# EAGLE schematic Resistor_Resistor (EAGLE 8.3.0), part 1 of 43 (continued)
## Parts (continued)
R323  10K  RESISTOR_0201  [0201]
R324  10K  RESISTOR_0201  [0201]
R325  10K  RESISTOR_0201  [0201]
R326  10K  RESISTOR_0201  [0201]
R327  10K  RESISTOR_0201  [0201]
R328  10K  RESISTOR_0201  [0201]
R329  10K  RESISTOR_0201  [0201]
R330  10K  RESISTOR_0201  [0201]
R331  10K  RESISTOR_0201  [0201]
R332  10K  RESISTOR_0201  [0201]
R333  10K  RESISTOR_0201  [0201]
R334  10K  RESISTOR_0201  [0201]
R335  10K  RESISTOR_0201  [0201]
R336  10K  RESISTOR_0201  [0201]
R337  10K  RESISTOR_0201  [0201]
R338  10K  RESISTOR_0201  [0201]
R339  10K  RESISTOR_0201  [0201]
R340  10K  RESISTOR_0201  [0201]
R341  10K  RESISTOR_0201  [0201]
R342  10K  RESISTOR_0201  [0201]
R343  10K  RESISTOR_0201  [0201]
R344  10K  RESISTOR_0201  [0201]
R345  10K  RESISTOR_0201  [0201]
R346  10K  RESISTOR_0201  [0201]
R347  10K  RESISTOR_0201  [0201]
R348  10K  RESISTOR_0201  [0201]
R349  10K  RESISTOR_0201  [0201]
R350  10K  RESISTOR_0201  [0201]
R351  10K  RESISTOR_0201  [0201]
R352  10K  RESISTOR_0201  [0201]
R353  10K  RESISTOR_0201  [0201]
R354  10K  RESISTOR_0201  [0201]
R355  10K  RESISTOR_0201  [0201]
R356  10K  RESISTOR_0201  [0201]
R357  10K  RESISTOR_0201  [0201]
R358  10K  RESISTOR_0201  [0201]
R359  10K  RESISTOR_0201  [0201]
R360  10K  RESISTOR_0201  [0201]
R361  10K  RESISTOR_0201  [0201]
R362  10K  RESISTOR_0201  [0201]
R363  10K  RESISTOR_0201  [0201]
R364  10K  RESISTOR_0201  [0201]
R365  10K  RESISTOR_0201  [0201]
R366  10K  RESISTOR_0201  [0201]
R367  10K  RESISTOR_0201  [0201]
R368  10K  RESISTOR_0201  [0201]
R369  10K  RESISTOR_0201  [0201]
R370  10K  RESISTOR_0201  [0201]
R371  10K  RESISTOR_0201  [0201]
R372  10K  RESISTOR_0201  [0201]
R373  10K  RESISTOR_0201  [0201]
R374  10K  RESISTOR_0201  [0201]
R375  10K  RESISTOR_0201  [0201]
R376  10K  RESISTOR_0201  [0201]
R377  10K  RESISTOR_0201  [0201]
R378  10K  RESISTOR_0201  [0201]
R379  10K  RESISTOR_0201  [0201]
R380  10K  RESISTOR_0201  [0201]
R381  10K  RESISTOR_0201  [0201]
R382  10K  RESISTOR_0201  [0201]
R383  10K  RESISTOR_0201  [0201]
R384  10K  RESISTOR_0201  [0201]
R385  10K  RESISTOR_0201  [0201]
R386  10K  RESISTOR_0201  [0201]
R387  10K  RESISTOR_0201  [0201]
R388  10K  RESISTOR_0201  [0201]
R389  10K  RESISTOR_0201  [0201]
R390  10K  RESISTOR_0201  [0201]
R391  10K  RESISTOR_0201  [0201]
R392  10K  RESISTOR_0201  [0201]
R393  10K  RESISTOR_0201  [0201]
R394  10K  RESISTOR_0201  [0201]
R395  10K  RESISTOR_0201  [0201]
R396  10K  RESISTOR_0201  [0201]
R397  10K  RESISTOR_0201  [0201]
R398  10K  RESISTOR_0201  [0201]
R399  10K  RESISTOR_0201  [0201]
R400  10K  RESISTOR_0201  [0201]
R401  10K  RESISTOR_0201  [0201]
R402  10K  RESISTOR_0201  [0201]
R403  10K  RESISTOR_0201  [0201]
R404  10K  RESISTOR_0201  [0201]
R405  10K  RESISTOR_0201  [0201]
R406  10K  RESISTOR_0201  [0201]
R407  10K  RESISTOR_0201  [0201]
R408  10K  RESISTOR_0201  [0201]
R409  10K  RESISTOR_0201  [0201]
R410  10K  RESISTOR_0201  [0201]
R411  10K  RESISTOR_0201  [0201]
R412  10K  RESISTOR_0201  [0201]
R413  10K  RESISTOR_0201  [0201]
R414  10K  RESISTOR_0201  [0201]
R415  10K  RESISTOR_0201  [0201]
R416  10K  RESISTOR_0201  [0201]
R417  10K  RESISTOR_0201  [0201]
R418  10K  RESISTOR_0201  [0201]
R419  10K  RESISTOR_0201  [0201]
R420  10K  RESISTOR_0201  [0201]
R421  10K  RESISTOR_0201  [0201]
R422  10K  RESISTOR_0201  [0201]
R423  10K  RESISTOR_0201  [0201]
R424  10K  RESISTOR_0201  [0201]
R425  10K  RESISTOR_0201  [0201]
R426  10K  RESISTOR_0201  [0201]
R427  10K  RESISTOR_0201  [0201]
R428  10K  RESISTOR_0201  [0201]
R429  10K  RESISTOR_0201  [0201]
R430  10K  RESISTOR_0201  [0201]
R431  10K  RESISTOR_0201  [0201]
R432  10K  RESISTOR_0201  [0201]
R433  10K  RESISTOR_0201  [0201]
R434  10K  RESISTOR_0201  [0201]
R435  10K  RESISTOR_0201  [0201]
R436  10K  RESISTOR_0201  [0201]
R437  10K  RESISTOR_0201  [0201]
R438  10K  RESISTOR_0201  [0201]
R439  10K  RESISTOR_0201  [0201]
R440  10K  RESISTOR_0201  [0201]
R441  10K  RESISTOR_0201  [0201]
R442  10K  RESISTOR_0201  [0201]
R443  10K  RESISTOR_0201  [0201]
R444  10K  RESISTOR_0201  [0201]
R445  10K  RESISTOR_0201  [0201]
R446  10K  RESISTOR_0201  [0201]
R447  10K  RESISTOR_0201  [0201]
R448  10K  RESISTOR_0201  [0201]
R449  10K  RESISTOR_0201  [0201]
R450  10K  RESISTOR_0201  [0201]
R451  10K  RESISTOR_0201  [0201]
R452  10K  RESISTOR_0201  [0201]
R453  10K  RESISTOR_0201  [0201]
R454  10K  RESISTOR_0201  [0201]
R455  10K  RESISTOR_0201  [0201]
R456  10K  RESISTOR_0201  [0201]
R457  10K  RESISTOR_0201  [0201]
R458  10K  RESISTOR_0201  [0201]
R459  10K  RESISTOR_0201  [0201]
R460  10K  RESISTOR_0201  [0201]
R461  10K  RESISTOR_0201  [0201]
R462  10K  RESISTOR_0201  [0201]
R463  10K  RESISTOR_0201  [0201]
R464  10K  RESISTOR_0201  [0201]
R465  10K  RESISTOR_0201  [0201]
R466  10K  RESISTOR_0201  [0201]
R467  10K  RESISTOR_0201  [0201]
R468  10K  RESISTOR_0201  [0201]
R469  10K  RESISTOR_0201  [0201]
R470  10K  RESISTOR_0201  [0201]
R471  10K  RESISTOR_0201  [0201]
R472  10K  RESISTOR_0201  [0201]
R473  10K  RESISTOR_0201  [0201]
R474  10K  RESISTOR_0201  [0201]
R475  10K  RESISTOR_0201  [0201]
R476  10K  RESISTOR_0201  [0201]
R477  10K  RESISTOR_0201  [0201]
R478  10K  RESISTOR_0201  [0201]
R479  10K  RESISTOR_0201  [0201]
R480  10K  RESISTOR_0201  [0201]
R481  10K  RESISTOR_0201  [0201]
R482  10K  RESISTOR_0201  [0201]
R483  10K  RESISTOR_0201  [0201]
R484  10K  RESISTOR_0201  [0201]
R485  10K  RESISTOR_0201  [0201]
R486  10K  RESISTOR_0201  [0201]
R487  10K  RESISTOR_0201  [0201]
R488  10K  RESISTOR_0201  [0201]
R489  10K  RESISTOR_0201  [0201]
R490  10K  RESISTOR_0201  [0201]
R491  10K  RESISTOR_0201  [0201]
R492  10K  RESISTOR_0201  [0201]
R493  10K  RESISTOR_0201  [0201]
R494  10K  RESISTOR_0201  [0201]
R495  10K  RESISTOR_0201  [0201]
R496  10K  RESISTOR_0201  [0201]
R497  10K  RESISTOR_0201  [0201]
R498  10K  RESISTOR_0201  [0201]
R499  10K  RESISTOR_0201  [0201]
R500  10K  RESISTOR_0201  [0201]
R501  10K  RESISTOR_0201  [0201]
R502  10K  RESISTOR_0201  [0201]
R503  10K  RESISTOR_0201  [0201]
R504  10K  RESISTOR_0201  [0201]
R505  10K  RESISTOR_0201  [0201]
R506  10K  RESISTOR_0201  [0201]
R507  10K  RESISTOR_0201  [0201]
R508  10K  RESISTOR_0201  [0201]
R509  10K  RESISTOR_0201  [0201]
R510  10K  RESISTOR_0201  [0201]
R511  10K  RESISTOR_0201  [0201]
R512  10K  RESISTOR_0201  [0201]
R513  10K  RESISTOR_0201  [0201]
R514  10K  RESISTOR_0201  [0201]
R515  10K  RESISTOR_0201  [0201]
R516  10K  RESISTOR_0201  [0201]
R517  10K  RESISTOR_0201  [0201]
R518  10K  RESISTOR_0201  [0201]
R519  10K  RESISTOR_0201  [0201]
R520  10K  RESISTOR_0201  [0201]
R521  10K  RESISTOR_0201  [0201]
R522  10K  RESISTOR_0201  [0201]
R523  10K  RESISTOR_0201  [0201]
R524  10K  RESISTOR_0201  [0201]
R525  10K  RESISTOR_0201  [0201]
R526  10K  RESISTOR_0201  [0201]
R527  10K  RESISTOR_0201  [0201]
R528  10K  RESISTOR_0201  [0201]
R529  10K  RESISTOR_0201  [0201]
R530  10K  RESISTOR_0201  [0201]
R531  10K  RESISTOR_0201  [0201]
R532  10K  RESISTOR_0201  [0201]
R533  10K  RESISTOR_0201  [0201]
R534  10K  RESISTOR_0201  [0201]
R535  10K  RESISTOR_0201  [0201]
R536  10K  RESISTOR_0201  [0201]
R537  10K  RESISTOR_0201  [0201]
R538  10K  RESISTOR_0201  [0201]
R539  10K  RESISTOR_0201  [0201]
R540  10K  RESISTOR_0201  [0201]
R541  10K  RESISTOR_0201  [0201]
R542  10K  RESISTOR_0201  [0201]
R543  10K  RESISTOR_0201  [0201]
R544  10K  RESISTOR_0201  [0201]
R545  10K  RESISTOR_0201  [0201]
R546  10K  RESISTOR_0201  [0201]
R547  10K  RESISTOR_0201  [0201]
R548  10K  RESISTOR_0201  [0201]
R549  10K  RESISTOR_0201  [0201]
R550  10K  RESISTOR_0201  [0201]
R551  10K  RESISTOR_0201  [0201]
R552  10K  RESISTOR_0201  [0201]
R553  10K  RESISTOR_0201  [0201]
R554  10K  RESISTOR_0201  [0201]
R555  10K  RESISTOR_0201  [0201]
R556  10K  RESISTOR_0201  [0201]
R557  10K  RESISTOR_0201  [0201]
R558  10K  RESISTOR_0201  [0201]
R559  10K  RESISTOR_0201  [0201]
R560  10K  RESISTOR_0201  [0201]
R561  10K  RESISTOR_0201  [0201]
R562  10K  RESISTOR_0201  [0201]
R563  10K  RESISTOR_0201  [0201]
R564  10K  RESISTOR_0201  [0201]
R565  10K  RESISTOR_0201  [0201]
R566  10K  RESISTOR_0201  [0201]
R567  10K  RESISTOR_0201  [0201]
R568  10K  RESISTOR_0201  [0201]
R569  10K  RESISTOR_0201  [0201]
R570  10K  RESISTOR_0201  [0201]
R571  10K  RESISTOR_0201  [0201]
R572  10K  RESISTOR_0201  [0201]
R573  10K  RESISTOR_0201  [0201]
R574  10K  RESISTOR_0201  [0201]
R575  10K  RESISTOR_0201  [0201]
R576  10K  RESISTOR_0201  [0201]
R577  10K  RESISTOR_0201  [0201]
R578  10K  RESISTOR_0201  [0201]
R579  10K  RESISTOR_0201  [0201]
R580  10K  RESISTOR_0201  [0201]
R581  10K  RESISTOR_0201  [0201]
R582  10K  RESISTOR_0201  [0201]
R583  10K  RESISTOR_0201  [0201]
R584  10K  RESISTOR_0201  [0201]
R585  10K  RESISTOR_0201  [0201]
R586  10K  RESISTOR_0201  [0201]
R587  10K  RESISTOR_0201  [0201]
R588  10K  RESISTOR_0201  [0201]
R589  10K  RESISTOR_0201  [0201]
R590  10K  RESISTOR_0201  [0201]
R591  10K  RESISTOR_0201  [0201]
R592  10K  RESISTOR_0201  [0201]
R593  10K  RESISTOR_0201  [0201]
R594  10K  RESISTOR_0201  [0201]
R595  10K  RESISTOR_0201  [0201]
R596  10K  RESISTOR_0201  [0201]
R597  10K  RESISTOR_0201  [0201]
R598  10K  RESISTOR_0201  [0201]
R599  10K  RESISTOR_0201  [0201]
R600  10K  RESISTOR_0201  [0201]
R601  10K  RESISTOR_0201  [0201]
R602  10K  RESISTOR_0201  [0201]
R603  10K  RESISTOR_0201  [0201]
R604  10K  RESISTOR_0201  [0201]
R605  10K  RESISTOR_0201  [0201]
R606  10K  RESISTOR_0201  [0201]
R607  10K  RESISTOR_0201  [0201]
R608  10K  RESISTOR_0201  [0201]
R609  10K  RESISTOR_0201  [0201]
R610  10K  RESISTOR_0201  [0201]
R611  10K  RESISTOR_0201  [0201]
R612  10K  RESISTOR_0201  [0201]
R613  10K  RESISTOR_0201  [0201]
R614  10K  RESISTOR_0201  [0201]
R615  10K  RESISTOR_0201  [0201]
R616  10K  RESISTOR_0201  [0201]
R617  10K  RESISTOR_0201  [0201]
R618  10K  RESISTOR_0201  [0201]
R619  10K  RESISTOR_0201  [0201]
R620  10K  RESISTOR_0201  [0201]
R621  10K  RESISTOR_0201  [0201]
R622  10K  RESISTOR_0201  [0201]
R623  10K  RESISTOR_0201  [0201]
R624  10K  RESISTOR_0201  [0201]
R625  10K  RESISTOR_0201  [0201]
R626  10K  RESISTOR_0201  [0201]
R627  10K  RESISTOR_0201  [0201]
R628  10K  RESISTOR_0201  [0201]
R629  10K  RESISTOR_0201  [0201]
R630  10K  RESISTOR_0201  [0201]
R631  10K  RESISTOR_0201  [0201]
R632  10K  RESISTOR_0201  [0201]
R633  10K  RESISTOR_0201  [0201]
R634  10K  RESISTOR_0201  [0201]
R635  10K  RESISTOR_0201  [0201]
R636  10K  RESISTOR_0201  [0201]
R637  10K  RESISTOR_0201  [0201]
R638  10K  RESISTOR_0201  [0201]
R639  10K  RESISTOR_0201  [0201]
R640  10K  RESISTOR_0201  [0201]
R641  10K  RESISTOR_0201  [0201]
R642  10K  RESISTOR_0201  [0201]
R643  10K  RESISTOR_0201  [0201]
R644  10K  RESISTOR_0201  [0201]
R645  10K  RESISTOR_0201  [0201]
R646  10K  RESISTOR_0201  [0201]
R647  10K  RESISTOR_0201  [0201]
R648  10K  RESISTOR_0201  [0201]
R649  10K  RESISTOR_0201  [0201]
R650  10K  RESISTOR_0201  [0201]
R651  10K  RESISTOR_0201  [0201]
R652  10K  RESISTOR_0201  [0201]
R653  10K  RESISTOR_0201  [0201]
R654  10K  RESISTOR_0201  [0201]
R655  10K  RESISTOR_0201  [0201]
R656  10K  RESISTOR_0201  [0201]
R657  10K  RESISTOR_0201  [0201]
R658  10K  RESISTOR_0201  [0201]
R659  10K  RESISTOR_0201  [0201]
R660  10K  RESISTOR_0201  [0201]
R661  10K  RESISTOR_0201  [0201]
R662  10K  RESISTOR_0201  [0201]
R663  10K  RESISTOR_0201  [0201]
R664  10K  RESISTOR_0201  [0201]
R665  10K  RESISTOR_0201  [0201]
R666  10K  RESISTOR_0201  [0201]
R667  10K  RESISTOR_0201  [0201]
R668  10K  RESISTOR_0201  [0201]
R669  10K  RESISTOR_0201  [0201]
R670  10K  RESISTOR_0201  [0201]
R671  10K  RESISTOR_0201  [0201]
R672  10K  RESISTOR_0201  [0201]
R673  10K  RESISTOR_0201  [0201]
R674  10K  RESISTOR_0201  [0201]
R675  10K  RESISTOR_0201  [0201]
R676  10K  RESISTOR_0201  [0201]
R677  10K  RESISTOR_0201  [0201]
R678  10K  RESISTOR_0201  [0201]
R679  10K  RESISTOR_0201  [0201]
R680  10K  RESISTOR_0201  [0201]
R681  10K  RESISTOR_0201  [0201]
R682  10K  RESISTOR_0201  [0201]
R683  10K  RESISTOR_0201  [0201]
R684  10K  RESISTOR_0201  [0201]
R685  10K  RESISTOR_0201  [0201]
R686  10K  RESISTOR_0201  [0201]
R687  10K  RESISTOR_0201  [0201]
R688  10K  RESISTOR_0201  [0201]
R689  10K  RESISTOR_0201  [0201]
R690  10K  RESISTOR_0201  [0201]
R691  10K  RESISTOR_0201  [0201]
R692  10K  RESISTOR_0201  [0201]
R693  10K  RESISTOR_0201  [0201]
R694  10K  RESISTOR_0201  [0201]
R695  10K  RESISTOR_0201  [0201]
R696  10K  RESISTOR_0201  [0201]
R697  10K  RESISTOR_0201  [0201]
R698  10K  RESISTOR_0201  [0201]
R699  10K  RESISTOR_0201  [0201]
R700  10K  RESISTOR_0201  [0201]
R701  10K  RESISTOR_0201  [0201]
R702  10K  RESISTOR_0201  [0201]
R703  10K  RESISTOR_0201  [0201]
R704  10K  RESISTOR_0201  [0201]
R705  10K  RESISTOR_0201  [0201]
R706  10K  RESISTOR_0201  [0201]
R707  10K  RESISTOR_0201  [0201]
R708  10K  RESISTOR_0201  [0201]
R709  10K  RESISTOR_0201  [0201]
R710  10K  RESISTOR_0201  [0201]
R711  10K  RESISTOR_0201  [0201]
R712  10K  RESISTOR_0201  [0201]
R713  10K  RESISTOR_0201  [0201]
R714  10K  RESISTOR_0201  [0201]
R715  10K  RESISTOR_0201  [0201]
R716  10K  RESISTOR_0201  [0201]
R717  10K  RESISTOR_0201  [0201]
R718  10K  RESISTOR_0201  [0201]
R719  10K  RESISTOR_0201  [0201]
R720  10K  RESISTOR_0201  [0201]
R721  10K  RESISTOR_0201  [0201]
R722  10K  RESISTOR_0201  [0201]
R723  10K  RESISTOR_0201  [0201]
R724  10K  RESISTOR_0201  [0201]
R725  10K  RESISTOR_0201  [0201]
R726  10K  RESISTOR_0201  [0201]
R727  10K  RESISTOR_0201  [0201]
R728  10K  RESISTOR_0201  [0201]
R729  10K  RESISTOR_0201  [0201]
R730  10K  RESISTOR_0201  [0201]
R731  10K  RESISTOR_0201  [0201]
R732  10K  RESISTOR_0201  [0201]
R733  10K  RESISTOR_0201  [0201]
R734  10K  RESISTOR_0201  [0201]
R735  10K  RESISTOR_0201  [0201]
R736  10K  RESISTOR_0201  [0201]
R737  10K  RESISTOR_0201  [0201]
R738  10K  RESISTOR_0201  [0201]
R739  10K  RESISTOR_0201  [0201]
R740  10K  RESISTOR_0201  [0201]
R741  10K  RESISTOR_0201  [0201]
R742  10K  RESISTOR_0201  [0201]
R743  10K  RESISTOR_0201  [0201]
R744  10K  RESISTOR_0201  [0201]
R745  10K  RESISTOR_0201  [0201]
R746  10K  RESISTOR_0201  [0201]
R747  10K  RESISTOR_0201  [0201]
R748  10K  RESISTOR_0201  [0201]
R749  10K  RESISTOR_0201  [0201]
R750  10K  RESISTOR_0201  [0201]
R751  10K  RESISTOR_0201  [0201]
R752  10K  RESISTOR_0201  [0201]
R753  10K  RESISTOR_0201  [0201]
R754  10K  RESISTOR_0201  [0201]
R755  10K  RESISTOR_0201  [0201]
R756  10K  RESISTOR_0201  [0201]
R757  10K  RESISTOR_0201  [0201]
R758  10K  RESISTOR_0201  [0201]
R759  10K  RESISTOR_0201  [0201]
R760  10K  RESISTOR_0201  [0201]
R761  10K  RESISTOR_0201  [0201]
R762  10K  RESISTOR_0201  [0201]
R763  10K  RESISTOR_0201  [0201]
R764  10K  RESISTOR_0201  [0201]
R765  10K  RESISTOR_0201  [0201]
R766  10K  RESISTOR_0201  [0201]
R767  10K  RESISTOR_0201  [0201]
R768  10K  RESISTOR_0201  [0201]
R769  10K  RESISTOR_0201  [0201]
R770  10K  RESISTOR_0201  [0201]
R771  10K  RESISTOR_0201  [0201]
R772  10K  RESISTOR_0201  [0201]
R773  10K  RESISTOR_0201  [0201]
R774  10K  RESISTOR_0201  [0201]
R775  10K  RESISTOR_0201  [0201]
R776  10K  RESISTOR_0201  [0201]
R777  10K  RESISTOR_0201  [0201]
R778  10K  RESISTOR_0201  [0201]
R779  10K  RESISTOR_0201  [0201]
R780  10K  RESISTOR_0201  [0201]
R781  10K  RESISTOR_0201  [0201]
R782  10K  RESISTOR_0201  [0201]
R783  10K  RESISTOR_0201  [0201]
R784  10K  RESISTOR_0201  [0201]
R785  10K  RESISTOR_0201  [0201]
R786  10K  RESISTOR_0201  [0201]
R787  10K  RESISTOR_0201  [0201]
R788  10K  RESISTOR_0201  [0201]
R789  10K  RESISTOR_0201  [0201]
R790  10K  RESISTOR_0201  [0201]
R791  10K  RESISTOR_0201  [0201]
R792  10K  RESISTOR_0201  [0201]
R793  10K  RESISTOR_0201  [0201]
R794  10K  RESISTOR_0201  [0201]
R795  10K  RESISTOR_0201  [0201]
R796  10K  RESISTOR_0201  [0201]
R797  10K  RESISTOR_0201  [0201]
R798  10K  RESISTOR_0201  [0201]
R799  10K  RESISTOR_0201  [0201]
R800  10K  RESISTOR_0201  [0201]
R801  10K  RESISTOR_0201  [0201]
R802  10K  RESISTOR_0201  [0201]
R803  10K  RESISTOR_0201  [0201]
R804  10K  RESISTOR_0201  [0201]
R805  10K  RESISTOR_0201  [0201]
R806  10K  RESISTOR_0201  [0201]
R807  10K  RESISTOR_0201  [0201]
R808  10K  RESISTOR_0201  [0201]
R809  10K  RESISTOR_0201  [0201]
R810  10K  RESISTOR_0201  [0201]
R811  10K  RESISTOR_0201  [0201]
R812  10K  RESISTOR_0201  [0201]
R813  10K  RESISTOR_0201  [0201]
R814  10K  RESISTOR_0201  [0201]
R815  10K  RESISTOR_0201  [0201]
R816  10K  RESISTOR_0201  [0201]
R817  10K  RESISTOR_0201  [0201]
R818  10K  RESISTOR_0201  [0201]
R819  10K  RESISTOR_0201  [0201]
R820  10K  RESISTOR_0201  [0201]
R821  10K  RESISTOR_0201  [0201]
R822  10K  RESISTOR_0201  [0201]
R823  10K  RESISTOR_0201  [0201]
R824  10K  RESISTOR_0201  [0201]
R825  10K  RESISTOR_0201  [0201]
R826  10K  RESISTOR_0201  [0201]
R827  10K  RESISTOR_0201  [0201]
R828  10K  RESISTOR_0201  [0201]
R829  10K  RESISTOR_0201  [0201]
R830  10K  RESISTOR_0201  [0201]
R831  10K  RESISTOR_0201  [0201]
R832  10K  RESISTOR_0201  [0201]
R833  10K  RESISTOR_0201  [0201]
R834  10K  RESISTOR_0201  [0201]
R835  10K  RESISTOR_0201  [0201]
R836  10K  RESISTOR_0201  [0201]
R837  10K  RESISTOR_0201  [0201]
R838  10K  RESISTOR_0201  [0201]
R839  10K  RESISTOR_0201  [0201]
R840  10K  RESISTOR_0201  [0201]
R841  10K  RESISTOR_0201  [0201]
R842  10K  RESISTOR_0201  [0201]
R843  10K  RESISTOR_0201  [0201]
R844  10K  RESISTOR_0201  [0201]
R845  10K  RESISTOR_0201  [0201]
R846  10K  RESISTOR_0201  [0201]
R847  10K  RESISTOR_0201  [0201]
R848  10K  RESISTOR_0201  [0201]
R849  10K  RESISTOR_0201  [0201]
R850  10K  RESISTOR_0201  [0201]
R851  10K  RESISTOR_0201  [0201]
R852  10K  RESISTOR_0201  [0201]
R853  10K  RESISTOR_0201  [0201]
R854  10K  RESISTOR_0201  [0201]
R855  10K  RESISTOR_0201  [0201]
R856  10K  RESISTOR_0201  [0201]
R857  10K  RESISTOR_0201  [0201]
R858  10K  RESISTOR_0201  [0201]
R859  10K  RESISTOR_0201  [0201]
R860  10K  RESISTOR_0201  [0201]
R861  10K  RESISTOR_0201  [0201]
R862  10K  RESISTOR_0201  [0201]
R863  10K  RESISTOR_0201  [0201]
R864  10K  RESISTOR_0201  [0201]
R865  10K  RESISTOR_0201  [0201]
R866  10K  RESISTOR_0201  [0201]
R867  10K  RESISTOR_0201  [0201]
R868  10K  RESISTOR_0201  [0201]
R869  10K  RESISTOR_0201  [0201]
R870  10K  RESISTOR_0201  [0201]
R871  10K  RESISTOR_0201  [0201]
R872  10K  RESISTOR_0201  [0201]
R873  10K  RESISTOR_0201  [0201]
R874  10K  RESISTOR_0201  [0201]
R875  10K  RESISTOR_0201  [0201]
R876  10K  RESISTOR_0201  [0201]
R877  10K  RESISTOR_0201  [0201]
R878  10K  RESISTOR_0201  [0201]
R879  10K  RESISTOR_0201  [0201]
R880  10K  RESISTOR_0201  [0201]
R881  10K  RESISTOR_0201  [0201]
R882  10K  RESISTOR_0201  [0201]
R883  10K  RESISTOR_0201  [0201]
R884  10K  RESISTOR_0201  [0201]
R885  10K  RESISTOR_0201  [0201]
R886  10K  RESISTOR_0201  [0201]
R887  10K  RESISTOR_0201  [0201]
R888  10K  RESISTOR_0201  [0201]
R889  10K  RESISTOR_0201  [0201]
R890  10K  RESISTOR_0201  [0201]
R891  10K  RESISTOR_0201  [0201]
R892  10K  RESISTOR_0201  [0201]
R893  10K  RESISTOR_0201  [0201]
R894  10K  RESISTOR_0201  [0201]
R895  10K  RESISTOR_0201  [0201]
R896  10K  RESISTOR_0201  [0201]
R897  10K  RESISTOR_0201  [0201]
R898  10K  RESISTOR_0201  [0201]
R899  10K  RESISTOR_0201  [0201]
R900  10K  RESISTOR_0201  [0201]
R901  10K  RESISTOR_0201  [0201]
R902  10K  RESISTOR_0201  [0201]
R903  10K  RESISTOR_0201  [0201]
R904  10K  RESISTOR_0201  [0201]
R905  10K  RESISTOR_0201  [0201]
R906  10K  RESISTOR_0201  [0201]
R907  10K  RESISTOR_0201  [0201]
R908  10K  RESISTOR_0201  [0201]
R909  10K  RESISTOR_0201  [0201]
R910  10K  RESISTOR_0201  [0201]
R911  10K  RESISTOR_0201  [0201]
R912  10K  RESISTOR_0201  [0201]
R913  10K  RESISTOR_0201  [0201]
R914  10K  RESISTOR_0201  [0201]
R915  10K  RESISTOR_0201  [0201]
R916  10K  RESISTOR_0201  [0201]
R917  10K  RESISTOR_0201  [0201]
R918  10K  RESISTOR_0201  [0201]
R919  10K  RESISTOR_0201  [0201]
R920  10K  RESISTOR_0201  [0201]
R921  10K  RESISTOR_0201  [0201]
R922  10K  RESISTOR_0201  [0201]
R923  10K  RESISTOR_0201  [0201]
R924  10K  RESISTOR_0201  [0201]
R925  10K  RESISTOR_0201  [0201]
R926  10K  RESISTOR_0201  [0201]
R927  10K  RESISTOR_0201  [0201]
R928  10K  RESISTOR_0201  [0201]
R929  10K  RESISTOR_0201  [0201]
R930  10K  RESISTOR_0201  [0201]
R931  10K  RESISTOR_0201  [0201]
R932  10K  RESISTOR_0201  [0201]
R933  10K  RESISTOR_0201  [0201]
R934  10K  RESISTOR_0201  [0201]
R935  10K  RESISTOR_0201  [0201]
R936  10K  RESISTOR_0201  [0201]
R937  10K  RESISTOR_0201  [0201]
R938  10K  RESISTOR_0201  [0201]
R939  10K  RESISTOR_0201  [0201]
R940  10K  RESISTOR_0201  [0201]
R941  10K  RESISTOR_0201  [0201]
R942  10K  RESISTOR_0201  [0201]
R943  10K  RESISTOR_0201  [0201]
R944  10K  RESISTOR_0201  [0201]
R945  10K  RESISTOR_0201  [0201]
R946  10K  RESISTOR_0201  [0201]
R947  10K  RESISTOR_0201  [0201]
R948  10K  RESISTOR_0201  [0201]
R949  10K  RESISTOR_0201  [0201]
R950  10K  RESISTOR_0201  [0201]
R951  10K  RESISTOR_0201  [0201]
R952  10K  RESISTOR_0201  [0201]
R953  10K  RESISTOR_0201  [0201]
R954  10K  RESISTOR_0201  [0201]
R955  10K  RESISTOR_0201  [0201]
R956  10K  RESISTOR_0201  [0201]
R957  10K  RESISTOR_0201  [0201]
R958  10K  RESISTOR_0201  [0201]
R959  10K  RESISTOR_0201  [0201]
R960  10K  RESISTOR_0201  [0201]
R961  10K  RESISTOR_0201  [0201]
R962  10K  RESISTOR_0201  [0201]
R963  10K  RESISTOR_0201  [0201]
R964  10K  RESISTOR_0201  [0201]
R965  10K  RESISTOR_0201  [0201]
R966  10K  RESISTOR_0201  [0201]
R967  10K  RESISTOR_0201  [0201]
R968  10K  RESISTOR_0201  [0201]
R969  10K  RESISTOR_0201  [0201]
R970  10K  RESISTOR_0201  [0201]
R971  10K  RESISTOR_0201  [0201]
R972  10K  RESISTOR_0201  [0201]
R973  10K  RESISTOR_0201  [0201]
R974  10K  RESISTOR_0201  [0201]
R975  10K  RESISTOR_0201  [0201]
R976  10K  RESISTOR_0201  [0201]
R977  10K  RESISTOR_0201  [0201]
R978  10K  RESISTOR_0201  [0201]
R979  10K  RESISTOR_0201  [0201]
R980  10K  RESISTOR_0201  [0201]
R981  10K  RESISTOR_0201  [0201]
R982  10K  RESISTOR_0201  [0201]
R983  10K  RESISTOR_0201  [0201]
R984  10K  RESISTOR_0201  [0201]
R985  10K  RESISTOR_0201  [0201]
R986  10K  RESISTOR_0201  [0201]
R987  10K  RESISTOR_0201  [0201]
R988  10K  RESISTOR_0201  [0201]
R989  10K  RESISTOR_0201  [0201]
R990  10K  RESISTOR_0201  [0201]
R991  10K  RESISTOR_0201  [0201]
R992  10K  RESISTOR_0201  [0201]
R993  10K  RESISTOR_0201  [0201]
R994  10K  RESISTOR_0201  [0201]
R995  10K  RESISTOR_0201  [0201]
R996  10K  RESISTOR_0201  [0201]
R997  10K  RESISTOR_0201  [0201]
R998  10K  RESISTOR_0201  [0201]
R999  10K  RESISTOR_0201  [0201]
R1000  10K  RESISTOR_0201  [0201]
R1001  10K  RESISTOR_0201  [0201]
R1002  10K  RESISTOR_0201  [0201]
R1003  10K  RESISTOR_0201  [0201]
R1004  10K  RESISTOR_0201  [0201]
R1005  10K  RESISTOR_0201  [0201]
R1006  10K  RESISTOR_0201  [0201]
R1007  10K  RESISTOR_0201  [0201]
R1008  10K  RESISTOR_0201  [0201]
R1009  10K  RESISTOR_0201  [0201]
R1010  10K  RESISTOR_0201  [0201]
R1011  10K  RESISTOR_0201  [0201]
R1012  10K  RESISTOR_0201  [0201]
R1013  10K  RESISTOR_0201  [0201]
R1014  10K  RESISTOR_0201  [0201]
R1015  10K  RESISTOR_0201  [0201]
R1016  10K  RESISTOR_0201  [0201]
R1017  10K  RESISTOR_0201  [0201]
R1018  10K  RESISTOR_0201  [0201]
R1019  10K  RESISTOR_0201  [0201]
R1020  10K  RESISTOR_0201  [0201]
R1021  10K  RESISTOR_0201  [0201]
R1022  10K  RESISTOR_0201  [0201]
R1023  10K  RESISTOR_0201  [0201]
R1024  10K  RESISTOR_0201  [0201]
R1025  10K  RESISTOR_0201  [0201]
R1026  10K  RESISTOR_0201  [0201]
R1027  10K  RESISTOR_0201  [0201]
R1028  10K  RESISTOR_0201  [0201]
R1029  10K  RESISTOR_0201  [0201]
R1030  10K  RESISTOR_0201  [0201]
R1031  10K  RESISTOR_0201  [0201]
R1032  10K  RESISTOR_0201  [0201]
R1033  10K  RESISTOR_0201  [0201]
R1034  10K  RESISTOR_0201  [0201]
R1035  10K  RESISTOR_0201  [0201]
R1036  10K  RESISTOR_0201  [0201]
R1037  10K  RESISTOR_0201  [0201]
R1038  10K  RESISTOR_0201  [0201]
R1039  10K  RESISTOR_0201  [0201]
R1040  10K  RESISTOR_0201  [0201]
R1041  10K  RESISTOR_0201  [0201]
R1042  10K  RESISTOR_0201  [0201]
R1043  10K  RESISTOR_0201  [0201]
R1044  10K  RESISTOR_0201  [0201]
R1045  10K  RESISTOR_0201  [0201]
R1046  10K  RESISTOR_0201  [0201]
R1047  10K  RESISTOR_0201  [0201]
R1048  10K  RESISTOR_0201  [0201]
R1049  10K  RESISTOR_0201  [0201]
R1050  10K  RESISTOR_0201  [0201]
R1051  10K  RESISTOR_0201  [0201]
R1052  10K  RESISTOR_0201  [0201]
R1053  10K  RESISTOR_0201  [0201]
R1054  10K  RESISTOR_0201  [0201]
R1055  10K  RESISTOR_0201  [0201]
R1056  10K  RESISTOR_0201  [0201]
R1057  10K  RESISTOR_0201  [0201]
R1058  10K  RESISTOR_0201  [0201]
R1059  10K  RESISTOR_0201  [0201]
R1060  10K  RESISTOR_0201  [0201]
R1061  10K  RESISTOR_0201  [0201]
R1062  10K  RESISTOR_0201  [0201]
R1063  10K  RESISTOR_0201  [0201]
R1064  10K  RESISTOR_0201  [0201]
R1065  10K  RESISTOR_0201  [0201]
R1066  10K  RESISTOR_0201  [0201]
R1067  10K  RESISTOR_0201  [0201]
R1068  10K  RESISTOR_0201  [0201]
R1069  10K  RESISTOR_0201  [0201]
R1070  10K  RESISTOR_0201  [0201]
R1071  10K  RESISTOR_0201  [0201]
R1072  10K  RESISTOR_0201  [0201]
R1073  10K  RESISTOR_0201  [0201]
R1074  10K  RESISTOR_0201  [0201]
R1075  10K  RESISTOR_0201  [0201]
R1076  10K  RESISTOR_0201  [0201]
R1077  10K  RESISTOR_0201  [0201]
R1078  10K  RESISTOR_0201  [0201]
R1079  10K  RESISTOR_0201  [0201]
R1080  10K  RESISTOR_0201  [0201]
R1081  10K  RESISTOR_0201  [0201]
R1082  10K  RESISTOR_0201  [0201]
R1083  10K  RESISTOR_0201  [0201]
R1084  10K  RESISTOR_0201  [0201]
R1085  10K  RESISTOR_0201  [0201]
R1086  10K  RESISTOR_0201  [0201]
R1087  10K  RESISTOR_0201  [0201]
R1088  10K  RESISTOR_0201  [0201]
R1089  10K  RESISTOR_0201  [0201]
R1090  10K  RESISTOR_0201  [0201]
R1091  10K  RESISTOR_0201  [0201]
R1092  10K  RESISTOR_0201  [0201]
R1093  10K  RESISTOR_0201  [0201]
R1094  10K  RESISTOR_0201  [0201]
R1095  10K  RESISTOR_0201  [0201]
R1096  10K  RESISTOR_0201  [0201]
R1097  10K  RESISTOR_0201  [0201]
R1098  10K  RESISTOR_0201  [0201]
R1099  10K  RESISTOR_0201  [0201]
R1100  10K  RESISTOR_0201  [0201]
R1101  10K  RESISTOR_0201  [0201]
R1102  10K  RESISTOR_0201  [0201]
R1103  10K  RESISTOR_0201  [0201]
R1104  10K  RESISTOR_0201  [0201]
R1105  10K  RESISTOR_0201  [0201]
R1106  10K  RESISTOR_0201  [0201]
R1107  10K  RESISTOR_0201  [0201]
R1108  10K  RESISTOR_0201  [0201]
R1109  10K  RESISTOR_0201  [0201]
R1110  10K  RESISTOR_0201  [0201]
R1111  10K  RESISTOR_0201  [0201]
R1112  10K  RESISTOR_0201  [0201]
R1113  10K  RESISTOR_0201  [0201]
R1114  10K  RESISTOR_0201  [0201]
R1115  10K  RESISTOR_0201  [0201]
R1116  10K  RESISTOR_0201  [0201]
R1117  10K  RESISTOR_0201  [0201]
R1118  10K  RESISTOR_0201  [0201]
R1119  10K  RESISTOR_0201  [0201]
R1120  10K  RESISTOR_0201  [0201]
R1121  10K  RESISTOR_0201  [0201]
R1122  10K  RESISTOR_0201  [0201]
R1123  10K  RESISTOR_0201  [0201]
R1124  10K  RESISTOR_0201  [0201]
R1125  10K  RESISTOR_0201  [0201]
R1126  10K  RESISTOR_0201  [0201]
R1127  10K  RESISTOR_0201  [0201]
R1128  10K  RESISTOR_0201  [0201]
R1129  10K  RESISTOR_0201  [0201]
R1130  10K  RESISTOR_0201  [0201]
R1131  10K  RESISTOR_0201  [0201]
R1132  10K  RESISTOR_0201  [0201]
R1133  10K  RESISTOR_0201  [0201]
R1134  10K  RESISTOR_0201  [0201]
R1135  10K  RESISTOR_0201  [0201]
R1136  10K  RESISTOR_0201  [0201]
R1137  10K  RESISTOR_0201  [0201]
R1138  10K  RESISTOR_0201  [0201]
R1139  10K  RESISTOR_0201  [0201]
R1140  10K  RESISTOR_0201  [0201]
R1141  10K  RESISTOR_0201  [0201]
R1142  10K  RESISTOR_0201  [0201]
R1143  10K  RESISTOR_0201  [0201]
R1144  10K  RESISTOR_0201  [0201]
R1145  10K  RESISTOR_0201  [0201]
R1146  10K  RESISTOR_0201  [0201]
R1147  10K  RESISTOR_0201  [0201]
R1148  10K  RESISTOR_0201  [0201]
R1149  10K  RESISTOR_0201  [0201]
R1150  10K  RESISTOR_0201  [0201]
R1151  10K  RESISTOR_0201  [0201]
R1152  10K  RESISTOR_0201  [0201]
R1153  10K  RESISTOR_0201  [0201]
R1154  10K  RESISTOR_0201  [0201]
R1155  10K  RESISTOR_0201  [0201]
R1156  10K  RESISTOR_0201  [0201]
R1157  10K  RESISTOR_0201  [0201]
R1158  10K  RESISTOR_0201  [0201]
R1159  10K  RESISTOR_0201  [0201]
R1160  10K  RESISTOR_0201  [0201]
R1161  10K  RESISTOR_0201  [0201]
R1162  10K  RESISTOR_0201  [0201]
R1163  10K  RESISTOR_0201  [0201]
R1164  10K  RESISTOR_0201  [0201]
R1165  10K  RESISTOR_0201  [0201]
R1166  10K  RESISTOR_0201  [0201]
R1167  10K  RESISTOR_0201  [0201]
R1168  10K  RESISTOR_0201  [0201]
R1169  10K  RESISTOR_0201  [0201]
R1170  10K  RESISTOR_0201  [0201]
R1171  10K  RESISTOR_0201  [0201]
R1172  10K  RESISTOR_0201  [0201]
R1173  10K  RESISTOR_0201  [0201]
R1174  10K  RESISTOR_0201  [0201]
R1175  10K  RESISTOR_0201  [0201]
R1176  10K  RESISTOR_0201  [0201]
R1177  10K  RESISTOR_0201  [0201]
R1178  10K  RESISTOR_0201  [0201]
R1179  10K  RESISTOR_0201  [0201]
R1180  10K  RESISTOR_0201  [0201]
R1181  10K  RESISTOR_0201  [0201]
R1182  10K  RESISTOR_0201  [0201]
R1183  10K  RESISTOR_0201  [0201]
R1184  10K  RESISTOR_0201  [0201]
R1185  10K  RESISTOR_0201  [0201]
R1186  10K  RESISTOR_0201  [0201]
R1187  10K  RESISTOR_0201  [0201]
R1188  10K  RESISTOR_0201  [0201]
R1189  10K  RESISTOR_0201  [0201]
R1190  10K  RESISTOR_0201  [0201]
R1191  10K  RESISTOR_0201  [0201]
R1192  10K  RESISTOR_0201  [0201]
R1193  10K  RESISTOR_0201  [0201]
R1194  10K  RESISTOR_0201  [0201]
R1195  10K  RESISTOR_0201  [0201]
R1196  10K  RESISTOR_0201  [0201]
R1197  10K  RESISTOR_0201  [0201]
R1198  10K  RESISTOR_0201  [0201]
R1199  10K  RESISTOR_0201  [0201]
R1200  10K  RESISTOR_0201  [0201]
R1201  10K  RESISTOR_0201  [0201]
R1202  10K  RESISTOR_0201  [0201]
R1203  10K  RESISTOR_0201  [0201]
R1204  10K  RESISTOR_0201  [0201]
R1205  10K  RESISTOR_0201  [0201]
R1206  10K  RESISTOR_0201  [0201]
R1207  10K  RESISTOR_0201  [0201]
R1208  10K  RESISTOR_0201  [0201]
R1209  10K  RESISTOR_0201  [0201]
R1210  10K  RESISTOR_0201  [0201]
R1211  10K  RESISTOR_0201  [0201]
R1212  10K  RESISTOR_0201  [0201]
R1213  10K  RESISTOR_0201  [0201]
R1214  10K  RESISTOR_0201  [0201]
R1215  10K  RESISTOR_0201  [0201]
R1216  10K  RESISTOR_0201  [0201]
R1217  10K  RESISTOR_0201  [0201]
R1218  10K  RESISTOR_0201  [0201]
R1219  10K  RESISTOR_0201  [0201]
R1220  10K  RESISTOR_0201  [0201]
R1221  10K  RESISTOR_0201  [0201]
R1222  10K  RESISTOR_0201  [0201]
R1223  10K  RESISTOR_0201  [0201]
R1224  10K  RESISTOR_0201  [0201]
R1225  10K  RESISTOR_0201  [0201]
R1226  10K  RESISTOR_0201  [0201]
R1227  10K  RESISTOR_0201  [0201]
R1228  10K  RESISTOR_0201  [0201]
R1229  10K  RESISTOR_0201  [0201]
R1230  10K  RESISTOR_0201  [0201]
R1231  10K  RESISTOR_0201  [0201]
R1232  10K  RESISTOR_0201  [0201]
R1233  10K  RESISTOR_0201  [0201]
R1234  10K  RESISTOR_0201  [0201]
R1235  10K  RESISTOR_0201  [0201]
R1236  10K  RESISTOR_0201  [0201]
R1237  10K  RESISTOR_0201  [0201]
R1238  10K  RESISTOR_0201  [0201]
R1239  10K  RESISTOR_0201  [0201]
R1240  10K  RESISTOR_0201  [0201]
R1241  10K  RESISTOR_0201  [0201]
R1242  10K  RESISTOR_0201  [0201]
R1243  10K  RESISTOR_0201  [0201]
R1244  10K  RESISTOR_0201  [0201]
R1245  10K  RESISTOR_0201  [0201]
R1246  10K  RESISTOR_0201  [0201]
R1247  10K  RESISTOR_0201  [0201]
R1248  10K  RESISTOR_0201  [0201]
R1249  10K  RESISTOR_0201  [0201]
R1250  10K  RESISTOR_0201  [0201]
R1251  10K  RESISTOR_0201  [0201]
R1252  10K  RESISTOR_0201  [0201]
R1253  10K  RESISTOR_0201  [0201]
R1254  10K  RESISTOR_0201  [0201]
R1255  10K  RESISTOR_0201  [0201]
R1256  10K  RESISTOR_0201  [0201]
R1257  10K  RESISTOR_0201  [0201]
R1258  10K  RESISTOR_0201  [0201]
R1259  10K  RESISTOR_0201  [0201]
R1260  10K  RESISTOR_0201  [0201]
R1261  10K  RESISTOR_0201  [0201]
R1262  10K  RESISTOR_0201  [0201]
R1263  10K  RESISTOR_0201  [0201]
R1264  10K  RESISTOR_0201  [0201]
R1265  10K  RESISTOR_0201  [0201]
R1266  10K  RESISTOR_0201  [0201]
R1267  10K  RESISTOR_0201  [0201]
R1268  10K  RESISTOR_0201  [0201]
R1269  10K  RESISTOR_0201  [0201]
R1270  10K  RESISTOR_0201  [0201]
R1271  10K  RESISTOR_0201  [0201]
R1272  10K  RESISTOR_0201  [0201]
R1273  10K  RESISTOR_0201  [0201]
R1274  10K  RESISTOR_0201  [0201]
R1275  10K  RESISTOR_0201  [0201]
R1276  10K  RESISTOR_0201  [0201]
R1277  10K  RESISTOR_0201  [0201]
R1278  10K  RESISTOR_0201  [0201]
R1279  10K  RESISTOR_0201  [0201]
R1280  10K  RESISTOR_0201  [0201]
R1281  10K  RESISTOR_0201  [0201]
R1282  10K  RESISTOR_0201  [0201]
R1283  10K  RESISTOR_0201  [0201]
R1284  10K  RESISTOR_0201  [0201]
R1285  10K  RESISTOR_0201  [0201]
R1286  10K  RESISTOR_0201  [0201]
R1287  10K  RESISTOR_0201  [0201]
R1288  10K  RESISTOR_0201  [0201]
R1289  10K  RESISTOR_0201  [0201]
R1290  10K  RESISTOR_0201  [0201]
R1291  10K  RESISTOR_0201  [0201]
R1292  10K  RESISTOR_0201  [0201]
R1293  10K  RESISTOR_0201  [0201]
R1294  10K  RESISTOR_0201  [0201]
R1295  10K  RESISTOR_0201  [0201]
R1296  10K  RESISTOR_0201  [0201]
R1297  10K  RESISTOR_0201  [0201]
R1298  10K  RESISTOR_0201  [0201]
R1299  10K  RESISTOR_0201  [0201]
R1300  10K  RESISTOR_0201  [0201]
R1301  10K  RESISTOR_0201  [0201]
R1302  10K  RESISTOR_0201  [0201]
R1303  10K  RESISTOR_0201  [0201]
R1304  10K  RESISTOR_0201  [0201]
R1305  10K  RESISTOR_0201  [0201]
R1306  10K  RESISTOR_0201  [0201]
R1307  10K  RESISTOR_0201  [0201]
R1308  10K  RESISTOR_0201  [0201]
R1309  10K  RESISTOR_0201  [0201]
R1310  10K  RESISTOR_0201  [0201]
R1311  10K  RESISTOR_0201  [0201]
R1312  10K  RESISTOR_0201  [0201]
R1313  10K  RESISTOR_0201  [0201]
R1314  10K  RESISTOR_0201  [0201]
R1315  10K  RESISTOR_0201  [0201]
R1316  10K  RESISTOR_0201  [0201]
R1317  10K  RESISTOR_0201  [0201]
R1318  10K  RESISTOR_0201  [0201]
R1319  10K  RESISTOR_0201  [0201]
R1320  10K  RESISTOR_0201  [0201]
R1321  10K  RESISTOR_0201  [0201]
R1322  10K  RESISTOR_0201  [0201]
R1323  10K  RESISTOR_0201  [0201]
R1324  10K  RESISTOR_0201  [0201]
R1325  10K  RESISTOR_0201  [0201]
R1326  10K  RESISTOR_0201  [0201]
R1327  10K  RESISTOR_0201  [0201]
R1328  10K  RESISTOR_0201  [0201]
R1329  10K  RESISTOR_0201  [0201]
R1330  10K  RESISTOR_0201  [0201]
R1331  10K  RESISTOR_0201  [0201]
R1332  10K  RESISTOR_0201  [0201]
R1333  10K  RESISTOR_0201  [0201]
R1334  10K  RESISTOR_0201  [0201]
R1335  10K  RESISTOR_0201  [0201]
R1336  10K  RESISTOR_0201  [0201]
R1337  10K  RESISTOR_0201  [0201]
R1338  10K  RESISTOR_0201  [0201]
R1339  10K  RESISTOR_0201  [0201]
R1340  10K  RESISTOR_0201  [0201]
R1341  10K  RESISTOR_0201  [0201]
R1342  10K  RESISTOR_0201  [0201]
R1343  10K  RESISTOR_0201  [0201]
R1344  10K  RESISTOR_0201  [0201]
R1345  10K  RESISTOR_0201  [0201]
R1346  10K  RESISTOR_0201  [0201]
R1347  10K  RESISTOR_0201  [0201]
R1348  10K  RESISTOR_0201  [0201]
R1349  10K  RESISTOR_0201  [0201]
R1350  10K  RESISTOR_0201  [0201]
R1351  10K  RESISTOR_0201  [0201]
R1352  10K  RESISTOR_0201  [0201]
R1353  10K  RESISTOR_0201  [0201]
R1354  10K  RESISTOR_0201  [0201]
R1355  10K  RESISTOR_0201  [0201]
R1356  10K  RESISTOR_0201  [0201]
R1357  10K  RESISTOR_0201  [0201]
R1358  10K  RESISTOR_0201  [0201]
R1359  10K  RESISTOR_0201  [0201]
R1360  10K  RESISTOR_0201  [0201]
R1361  10K  RESISTOR_0201  [0201]
R1362  10K  RESISTOR_0201  [0201]
R1363  10K  RESISTOR_0201  [0201]
R1364  10K  RESISTOR_0201  [0201]
R1365  10K  RESISTOR_0201  [0201]
R1366  10K  RESISTOR_0201  [0201]
R1367  10K  RESISTOR_0201  [0201]
R1368  10K  RESISTOR_0201  [0201]
R1369  10K  RESISTOR_0201  [0201]
R1370  10K  RESISTOR_0201  [0201]
R1371  10K  RESISTOR_0201  [0201]
R1372  10K  RESISTOR_0201  [0201]
R1373  10K  RESISTOR_0201  [0201]
R1374  10K  RESISTOR_0201  [0201]
R1375  10K  RESISTOR_0201  [0201]
R1376  10K  RESISTOR_0201  [0201]
R1377  10K  RESISTOR_0201  [0201]
R1378  10K  RESISTOR_0201  [0201]
R1379  10K  RESISTOR_0201  [0201]
R1380  10K  RESISTOR_0201  [0201]
R1381  10K  RESISTOR_0201  [0201]
R1382  10K  RESISTOR_0201  [0201]
R1383  10K  RESISTOR_0201  [0201]
R1384  10K  RESISTOR_0201  [0201]
R1385  10K  RESISTOR_0201  [0201]
R1386  10K  RESISTOR_0201  [0201]
R1387  10K  RESISTOR_0201  [0201]
R1388  10K  RESISTOR_0201  [0201]
R1389  10K  RESISTOR_0201  [0201]
R1390  10K  RESISTOR_0201  [0201]
R1391  10K  RESISTOR_0201  [0201]
R1392  10K  RESISTOR_0201  [0201]
R1393  10K  RESISTOR_0201  [0201]
R1394  10K  RESISTOR_0201  [0201]
R1395  10K  RESISTOR_0201  [0201]
R1396  10K  RESISTOR_0201  [0201]
R1397  10K  RESISTOR_0201  [0201]
R1398  10K  RESISTOR_0201  [0201]
R1399  10K  RESISTOR_0201  [0201]
R1400  10K  RESISTOR_0201  [0201]
R1401  10K  RESISTOR_0201  [0201]
R1402  10K  RESISTOR_0201  [0201]
R1403  10K  RESISTOR_0201  [0201]
R1404  10K  RESISTOR_0201  [0201]
R1405  10K  RESISTOR_0201  [0201]
R1406  10K  RESISTOR_0201  [0201]
R1407  10K  RESISTOR_0201  [0201]
R1408  10K  RESISTOR_0201  [0201]
R1409  10K  RESISTOR_0201  [0201]
R1410  10K  RESISTOR_0201  [0201]
R1411  10K  RESISTOR_0201  [0201]
R1412  10K  RESISTOR_0201  [0201]
R1413  10K  RESISTOR_0201  [0201]
R1414  10K  RESISTOR_0201  [0201]
R1415  10K  RESISTOR_0201  [0201]
R1416  10K  RESISTOR_0201  [0201]
R1417  10K  RESISTOR_0201  [0201]
R1418  10K  RESISTOR_0201  [0201]
R1419  10K  RESISTOR_0201  [0201]
R1420  10K  RESISTOR_0201  [0201]
R1421  10K  RESISTOR_0201  [0201]
R1422  10K  RESISTOR_0201  [0201]
R1423  10K  RESISTOR_0201  [0201]
R1424  10K  RESISTOR_0201  [0201]
R1425  10K  RESISTOR_0201  [0201]
R1426  10K  RESISTOR_0201  [0201]
R1427  10K  RESISTOR_0201  [0201]
R1428  10K  RESISTOR_0201  [0201]
R1429  10K  RESISTOR_0201  [0201]
R1430  10K  RESISTOR_0201  [0201]
R1431  10K  RESISTOR_0201  [0201]
R1432  10K  RESISTOR_0201  [0201]
R1433  10K  RESISTOR_0201  [0201]
R1434  10K  RESISTOR_0201  [0201]
R1435  10K  RESISTOR_0201  [0201]
R1436  10K  RESISTOR_0201  [0201]
R1437  10K  RESISTOR_0201  [0201]
R1438  10K  RESISTOR_0201  [0201]
R1439  10K  RESISTOR_0201  [0201]
R1440  10K  RESISTOR_0201  [0201]
R1441  10K  RESISTOR_0201  [0201]
R1442  10K  RESISTOR_0201  [0201]
R1443  10K  RESISTOR_0201  [0201]
R1444  10K  RESISTOR_0201  [0201]
R1445  10K  RESISTOR_0201  [0201]
R1446  10K  RESISTOR_0201  [0201]
R1447  10K  RESISTOR_0201  [0201]
R1448  10K  RESISTOR_0201  [0201]
R1449  10K  RESISTOR_0201  [0201]
R1450  10K  RESISTOR_0201  [0201]
R1451  10K  RESISTOR_0201  [0201]
R1452  10K  RESISTOR_0201  [0201]
R1453  10K  RESISTOR_0201  [0201]
R1454  10K  RESISTOR_0201  [0201]
R1455  10K  RESISTOR_0201  [0201]
R1456  10K  RESISTOR_0201  [0201]
R1457  10K  RESISTOR_0201  [0201]
R1458  10K  RESISTOR_0201  [0201]
R1459  10K  RESISTOR_0201  [0201]
R1460  10K  RESISTOR_0201  [0201]
R1461  10K  RESISTOR_0201  [0201]
R1462  10K  RESISTOR_0201  [0201]
R1463  10K  RESISTOR_0201  [0201]
R1464  10K  RESISTOR_0201  [0201]
R1465  10K  RESISTOR_0201  [0201]
R1466  10K  RESISTOR_0201  [0201]
R1467  10K  RESISTOR_0201  [0201]
R1468  10K  RESISTOR_0201  [0201]
R1469  10K  RESISTOR_0201  [0201]
R1470  10K  RESISTOR_0201  [0201]
R1471  10K  RESISTOR_0201  [0201]
R1472  10K  RESISTOR_0201  [0201]
R1473  10K  RESISTOR_0201  [0201]
R1474  10K  RESISTOR_0201  [0201]
R1475  10K  RESISTOR_0201  [0201]
R1476  10K  RESISTOR_0201  [0201]
R1477  10K  RESISTOR_0201  [0201]
R1478  10K  RESISTOR_0201  [0201]